# EAGLE design BMS-LV (EAGLE 6.5.0)
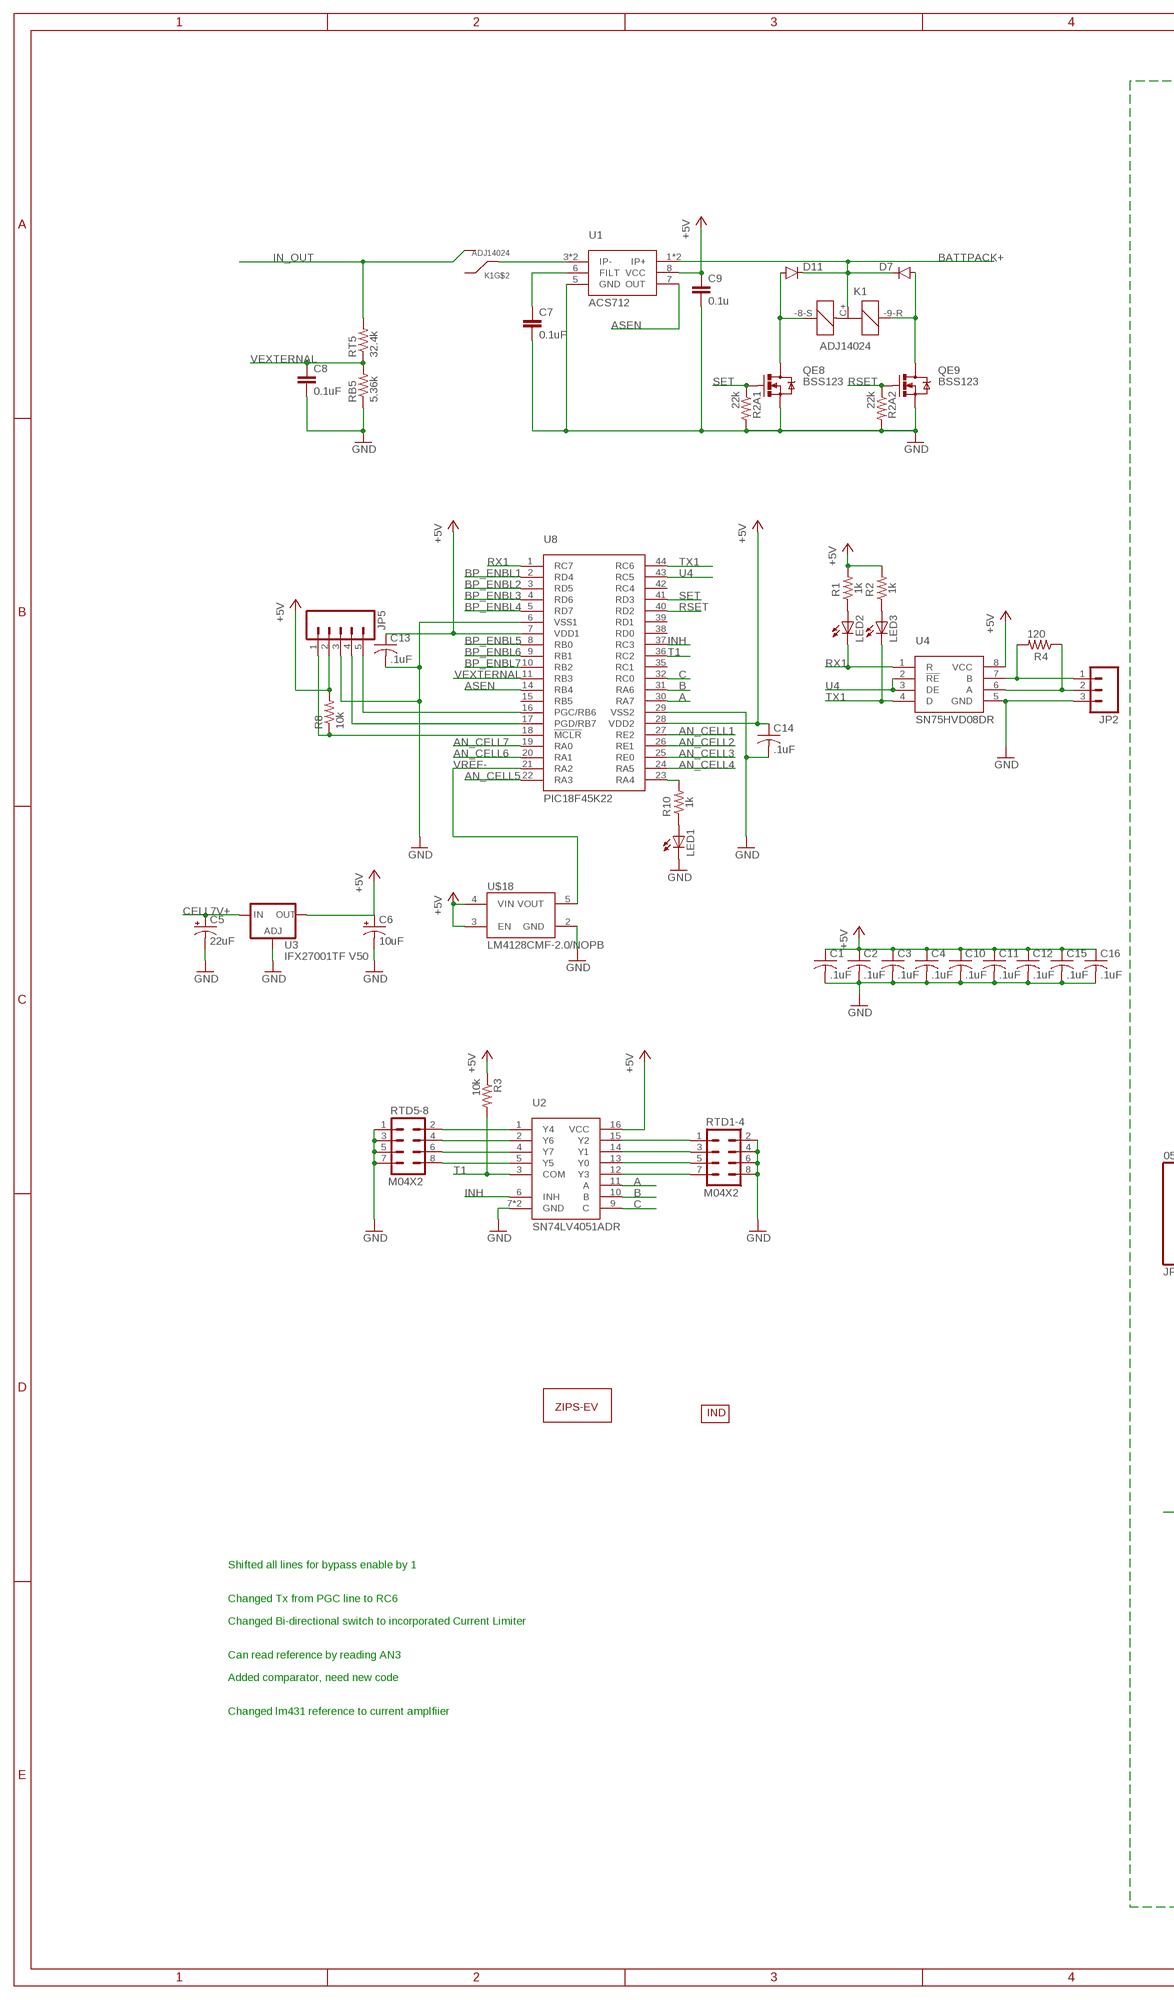
[diagram p0: schematic, sheet 1, part 1 of 2]
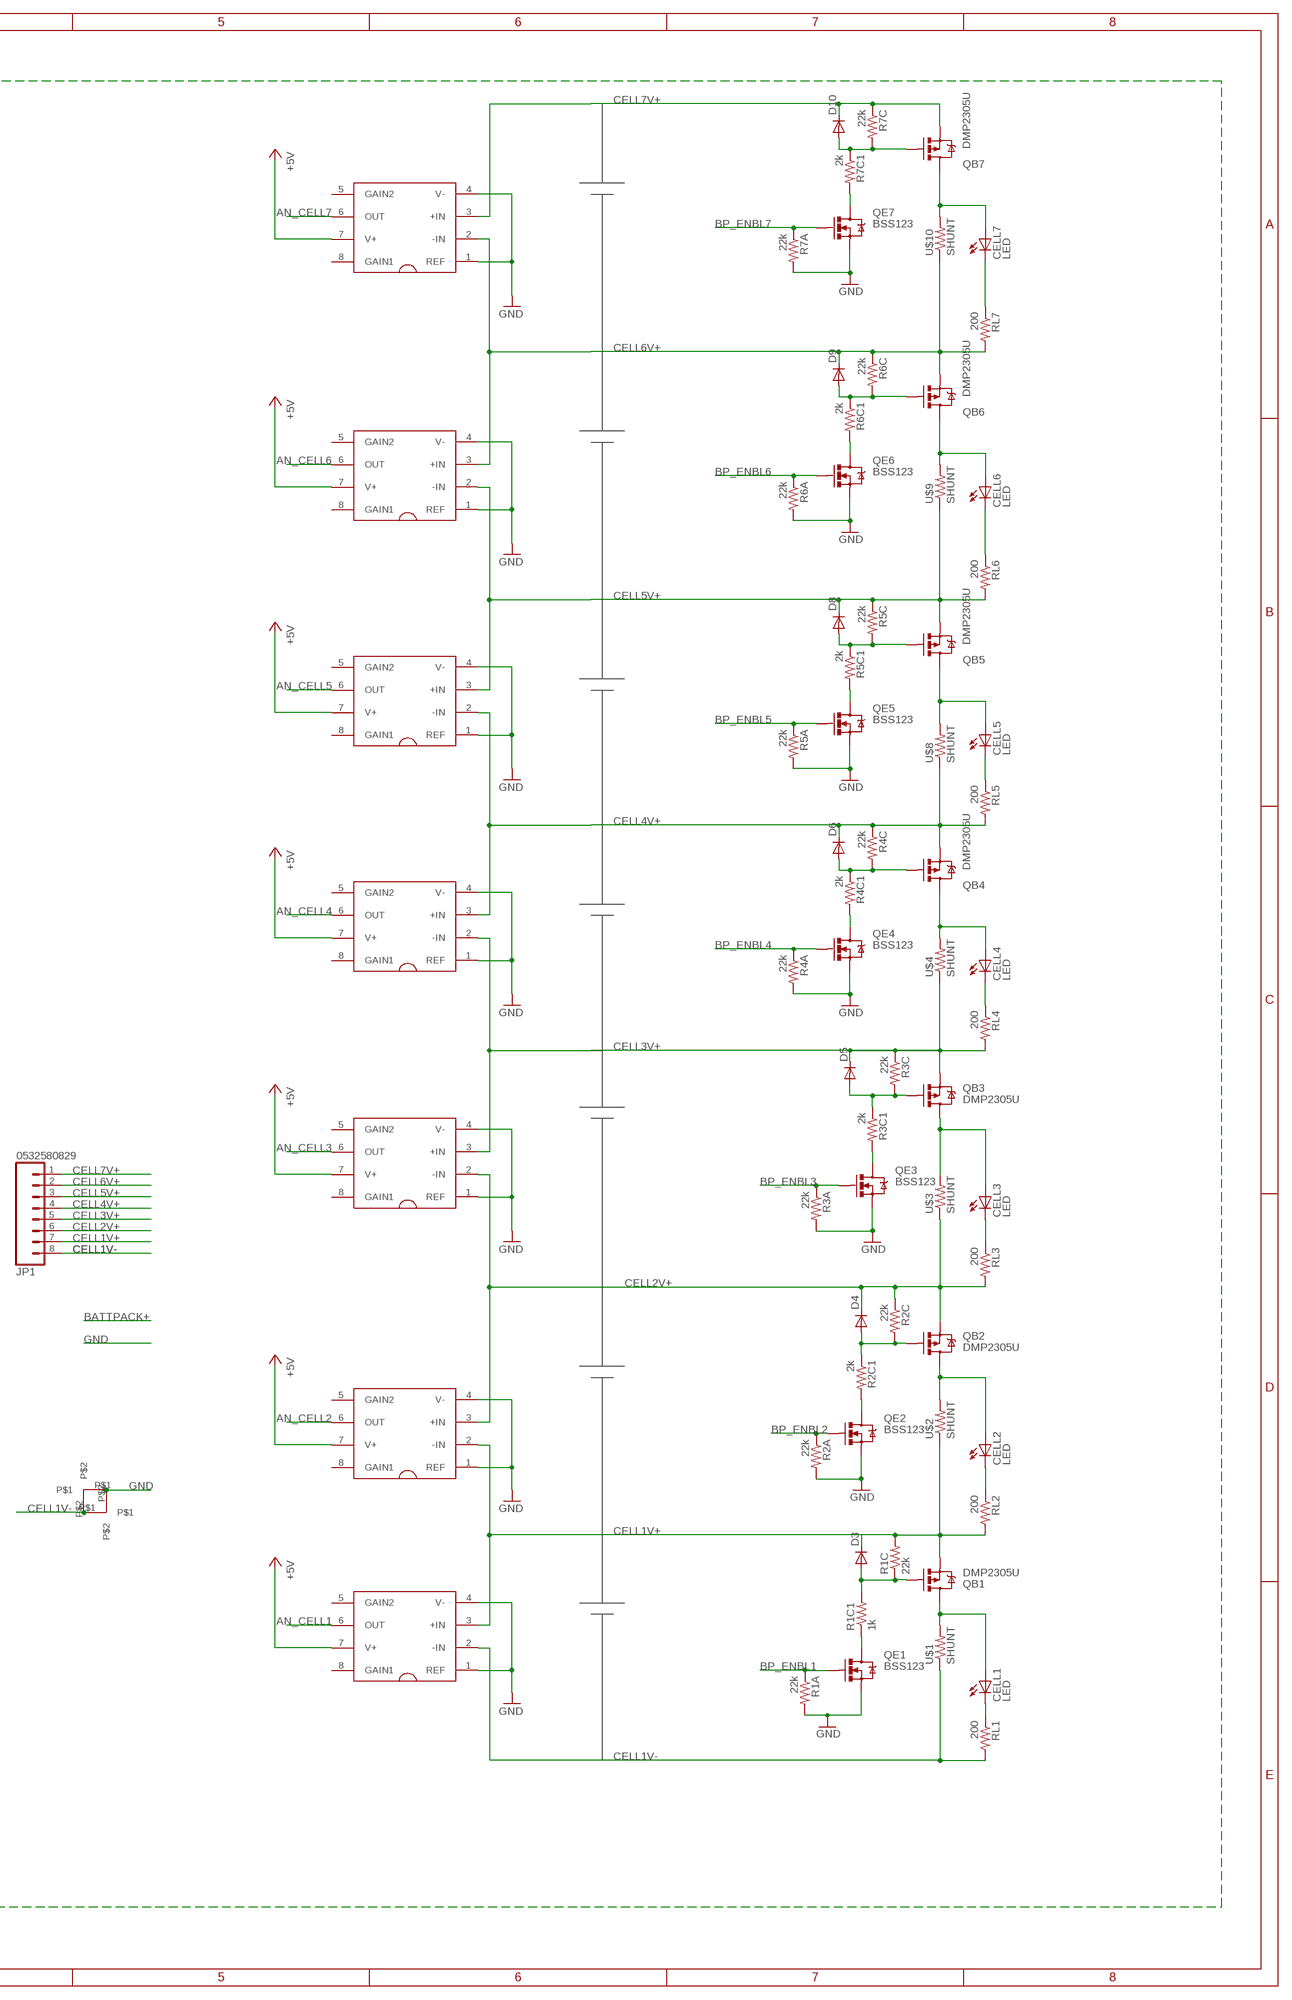
[diagram p1: schematic, sheet 1, part 2 of 2]

## Parts
C1  .1uF  C-USC0805  [C0805]
C2  .1uF  C-USC0805  [C0805]
C3  .1uF  C-USC0805  [C0805]
C4  .1uF  C-USC0805  [C0805]
C5  22uF  CAP_POL7343  [EIA7343]
C6  10uF  CAP_POL1206  [EIA3216]
C7  0.1uF  CAP0805  [0805]
C8  0.1uF  CAP0805  [0805]
C9  0.1u  CAP0805  [0805]
C10  .1uF  C-USC0805  [C0805]
C11  .1uF  C-USC0805  [C0805]
C12  .1uF  C-USC0805  [C0805]
C13  .1uF  C-USC0805  [C0805]
C14  .1uF  C-USC0805  [C0805]
C15  .1uF  C-USC0805  [C0805]
C16  .1uF  C-USC0805  [C0805]
CELL1  LED  LEDSML0805  [SML0805]
CELL2  LED  LEDSML0805  [SML0805]
CELL3  LED  LEDSML0805  [SML0805]
CELL4  LED  LEDSML0805  [SML0805]
CELL5  LED  LEDSML0805  [SML0805]
CELL6  LED  LEDSML0805  [SML0805]
CELL7  LED  LEDSML0805  [SML0805]
D3  DIODE-SOD123  [SOD123]
D4  DIODE-SOD123  [SOD123]
D5  DIODE-SOD123  [SOD123]
D6  DIODE-SOD123  [SOD123]
D7  DIODESMA-ALT  [SMA-DIODE_ALT]
D8  DIODE-SOD123  [SOD123]
D9  DIODE-SOD123  [SOD123]
D10  DIODE-SOD123  [SOD123]
D11  DIODESMA-ALT  [SMA-DIODE_ALT]
JP1  0532580829  M083.5MM-8  [SCREWTERMINAL-3.5MM-8]
JP2  M03POLAR_LOCK  [MOLEX-1X3_LOCK]
JP5  M05LOCK_LONGPADS  [1X05_LOCK_LONGPADS]
K1  ADJ14024  [ADJ14024]
LED1  LEDCHIP-LED0805  [CHIP-LED0805]
LED2  LEDCHIP-LED0805  [CHIP-LED0805]
LED3  LEDCHIP-LED0805  [CHIP-LED0805]
QB1  DMP2305U  [SOT-23]
QB2  DMP2305U  [SOT-23]
QB3  DMP2305U  [SOT-23]
QB4  DMP2305U  [SOT-23]
QB5  DMP2305U  [SOT-23]
QB6  DMP2305U  [SOT-23]
QB7  DMP2305U  [SOT-23]
QE1  BSS123  [SOT-23]
QE2  BSS123  [SOT-23]
QE3  BSS123  [SOT-23]
QE4  BSS123  [SOT-23]
QE5  BSS123  [SOT-23]
QE6  BSS123  [SOT-23]
QE7  BSS123  [SOT-23]
QE8  BSS123  [SOT-23]
QE9  BSS123  [SOT-23]
R1  1k  R-US_R0805  [R0805]
R1A  22k  RESISTOR0805-RES  [0805]
R1C  22k  RESISTOR0805-RES  [0805]
R1C1  1k  RESISTOR0805-RES  [0805]
R2  1k  R-US_R0805  [R0805]
R2A  22k  RESISTOR0805-RES  [0805]
R2A1  22k  RESISTOR0805-RES  [0805]
R2A2  22k  RESISTOR0805-RES  [0805]
R2C  22k  RESISTOR0805-RES  [0805]
R2C1  2k  RESISTOR0805-RES  [0805]
R3  10k  R-US_R0805  [R0805]
R3A  22k  RESISTOR0805-RES  [0805]
R3C  22k  RESISTOR0805-RES  [0805]
R3C1  2k  RESISTOR0805-RES  [0805]
R4  120  R-US_R0805  [R0805]
R4A  22k  RESISTOR0805-RES  [0805]
R4C  22k  RESISTOR0805-RES  [0805]
R4C1  2k  RESISTOR0805-RES  [0805]
R5A  22k  RESISTOR0805-RES  [0805]
R5C  22k  RESISTOR0805-RES  [0805]
R5C1  2k  RESISTOR0805-RES  [0805]
R6A  22k  RESISTOR0805-RES  [0805]
R6C  22k  RESISTOR0805-RES  [0805]
R6C1  2k  RESISTOR0805-RES  [0805]
R7A  22k  RESISTOR0805-RES  [0805]
R7C  22k  RESISTOR0805-RES  [0805]
R7C1  2k  RESISTOR0805-RES  [0805]
R8  10k  RESISTOR0805-RES  [0805]
R10  1k  R-US_R0805  [R0805]
RB5  5.36k  RESISTOR0805-RES  [0805]
RL1  200  RESISTOR0805-RES  [0805]
RL2  200  RESISTOR0805-RES  [0805]
RL3  200  RESISTOR0805-RES  [0805]
RL4  200  RESISTOR0805-RES  [0805]
RL5  200  RESISTOR0805-RES  [0805]
RL6  200  RESISTOR0805-RES  [0805]
RL7  200  RESISTOR0805-RES  [0805]
RT5  32.4k  RESISTOR0805-RES  [0805]
RTD1-4  M04X2  [2X4]
RTD5-8  M04X2  [2X4]
U1  ACS712  [SO-8]
U2  SN74LV4051ADR  [SO-16]
U3  IFX27001TF V50  V_REG_317DPACK  [V-REG_DPACK]
U4  SN75HVD08DR  [SO-8]
U8  PIC18F45K22  [TQFP-44]
U$1  SHUNT  [SM-5]
U$2  SHUNT  [SM-5]
U$3  SHUNT  [SM-5]
U$4  SHUNT  [SM-5]
U$5  VIRTUALGROUND  [VIRTUALSHORT]
U$7  VIRTUALGROUND  [VIRTUALSHORT]
U$8  SHUNT  [SM-5]
U$9  SHUNT  [SM-5]
U$10  SHUNT  [SM-5]
U$11  LT1990  [LT1990]
U$12  LT1990  [LT1990]
U$13  LT1990  [LT1990]
U$14  LT1990  [LT1990]
U$15  LT1990  [LT1990]
U$16  LT1990  [LT1990]
U$17  LT1990  [LT1990]
U$18  LM4128CMF-2.0/NOPB  LM4128-2.5VREF  [SOT23-5]
U$19  INDPK1  [PICKIT-PIN-1]
U$20  LOGO  [L-MS]

## Nets
+5V: C1.1 C2.1 C3.1 C4.1 C6.A(+) C9.1 C10.1 C11.1 C12.1 C13.1 C14.1 C15.1 C16.1 JP5.2 R1.2 R2.2 R3.1 R8.2 U1.8(VCC) U2.16(VCC) U3.4(OUT) U4.8(VCC) U8.7(VDD1) U8.28(VDD2) U$11.7(V+) U$12.7(V+) U$13.7(V+) U$14.7(V+) U$15.7(V+) U$16.7(V+) U$17.7(V+) U$18.3(EN) U$18.4(VIN)
A: U2.11(A) U8.30(RA7)
AN_CELL1: U8.27(RE2) U$11.6(OUT)
AN_CELL2: U8.26(RE1) U$12.6(OUT)
AN_CELL3: U8.25(RE0) U$13.6(OUT)
AN_CELL4: U8.24(RA5) U$14.6(OUT)
AN_CELL5: U8.22(RA3) U$15.6(OUT)
AN_CELL6: U8.20(RA1) U$16.6(OUT)
AN_CELL7: U8.19(RA0) U$17.6(OUT)
ASEN: U1.7(OUT) U8.14(RB4)
B: U2.10(B) U8.31(RA6)
BATTPACK+: D7.C D11.C K1.C+(-) U1.1(IP+) U1.2(IP+)
BP_ENBL1: QE1.1(G) R1A.1 U8.2(RD4)
BP_ENBL2: QE2.1(G) R2A.1 U8.3(RD5)
BP_ENBL3: QE3.1(G) R3A.1 U8.4(RD6)
BP_ENBL4: QE4.1(G) R4A.1 U8.5(RD7)
BP_ENBL5: QE5.1(G) R5A.1 U8.8(RB0)
BP_ENBL6: QE6.1(G) R6A.1 U8.9(RB1)
BP_ENBL7: QE7.1(G) R7A.1 U8.10(RB2)
C: U2.9(C) U8.32(RC0)
CELL1V+: D3.C JP1.7 QB1.2(S) R1C.2 RL2.2 U$2.P$1 U$11.3(+IN) U$12.2(-IN)
CELL1V-: JP1.8 RL1.2 U$1.P$1 U$5.P$1 U$7.P$2 U$11.2(-IN)
CELL2V+: D4.C JP1.6 QB2.2(S) R2C.1 RL3.2 U$3.P$1 U$12.3(+IN) U$13.2(-IN)
CELL3V+: D5.C JP1.5 QB3.2(S) R3C.1 RL4.2 U$4.P$1 U$13.3(+IN) U$14.2(-IN)
CELL4V+: D6.C JP1.4 QB4.2(S) R4C.1 RL5.2 U$8.P$1 U$14.3(+IN) U$15.2(-IN)
CELL5V+: D8.C JP1.3 QB5.2(S) R5C.1 RL6.2 U$9.P$1 U$15.3(+IN) U$16.2(-IN)
CELL6V+: D9.C JP1.2 QB6.2(S) R6C.1 RL7.2 U$10.P$1 U$16.3(+IN) U$17.2(-IN)
CELL7V+: C5.A(+) D10.C JP1.1 QB7.2(S) R7C.1 U3.3(IN) U$17.3(+IN)
GND: C1.2 C2.2 C3.2 C4.2 C5.C(-) C6.C(-) C7.2 C8.2 C9.2 C10.2 C11.2 C12.2 C13.2 C14.2 C15.2 C16.2 JP2.3 JP5.3 LED1.C QE1.2(S) QE2.2(S) QE3.2(S) QE4.2(S) QE5.2(S) QE6.2(S) QE7.2(S) QE8.2(S) QE9.2(S) R1A.2 R2A1.2 R2A2.2 R2A.2 R3A.2 R4A.2 R5A.2 R6A.2 R7A.2 RB5.1 RTD1-4.2 RTD1-4.4 RTD1-4.6 RTD1-4.8 RTD5-8.1 RTD5-8.3 RTD5-8.5 RTD5-8.7 U1.5(GND) U2.7(GND) U2.8(GND) U3.1(ADJ) U4.5(GND) U8.6(VSS1) U8.29(VSS2) U$5.P$2 U$7.P$1 U$11.1(REF) U$11.4(V-) U$12.1(REF) U$12.4(V-) U$13.1(REF) U$13.4(V-) U$14.1(REF) U$14.4(V-) U$15.1(REF) U$15.4(V-) U$16.1(REF) U$16.4(V-) U$17.1(REF) U$17.4(V-) U$18.2(GND)
IN_OUT: K1.NO RT5.2
INH: U2.6(INH) U8.37(RC3)
N$1: LED2.A R1.1
N$3: LED3.A R2.1
N$5: D4.A QB2.1(G) R2C1.1 R2C.2
N$7: D11.A K1.-8-S(+1) QE8.3(D)
N$10: JP5.4 U8.17(PGD/RB7)
N$11: QE1.3(D) R1C1.1
N$12: D5.A QB3.1(G) R3C1.1 R3C.2
N$13: D6.A QB4.1(G) R4C1.1 R4C.2
N$14: D3.A QB1.1(G) R1C1.2 R1C.1
N$15: CELL1.A QB1.3(D) U$1.P$2
N$17: K1.C U1.3(IP-) U1.4(IP-)
N$18: CELL2.A QB2.3(D) U$2.P$2
N$19: CELL4.A QB4.3(D) U$4.P$2
N$20: D7.A K1.-9-R(+2) QE9.3(D)
N$21: CELL1.C RL1.1
N$22: QE4.3(D) R4C1.2
N$23: CELL3.C RL3.1
N$24: R10.2 U8.23(RA4)
N$25: CELL3.A QB3.3(D) U$3.P$2
N$26: RTD1-4.1 U2.15(Y2)
N$27: C7.1 U1.6(FILT)
N$28: RTD1-4.3 U2.14(Y1)
N$29: JP2.2 R4.1 U4.6(A)
N$30: RTD1-4.5 U2.13(Y0)
N$31: RTD1-4.7 U2.12(Y3)
N$32: CELL2.C RL2.1
N$33: JP2.1 R4.2 U4.7(B)
N$34: CELL4.C RL4.1
N$35: QE2.3(D) R2C1.2
N$36: QE3.3(D) R3C1.2
N$39: JP5.5 U8.16(PGC/RB6)
N$42: RTD5-8.2 U2.1(Y4)
N$44: D8.A QB5.1(G) R5C1.1 R5C.2
N$45: CELL5.A QB5.3(D) U$8.P$2
N$46: CELL5.C RL5.1
N$48: QE5.3(D) R5C1.2
N$50: D9.A QB6.1(G) R6C1.1 R6C.2
N$51: CELL6.A QB6.3(D) U$9.P$2
N$52: CELL6.C RL6.1
N$53: D10.A QB7.1(G) R7C1.1 R7C.2
N$54: QE6.3(D) R6C1.2
N$55: CELL7.A QB7.3(D) U$10.P$2
N$56: CELL7.C RL7.1
N$57: QE7.3(D) R7C1.2
N$58: JP5.1 R8.1 U8.18(!MCLR)
N$59: LED1.A R10.1
N$60: RTD5-8.4 U2.2(Y6)
N$61: RTD5-8.6 U2.4(Y7)
N$62: RTD5-8.8 U2.5(Y5)
RSET: QE9.1(G) R2A2.1 U8.40(RD2)
RX1: LED2.C U4.1(R) U8.1(RC7)
SET: QE8.1(G) R2A1.1 U8.41(RD3)
T1: R3.2 U2.3(COM) U8.36(RC2)
TX1: LED3.C U4.4(D) U8.44(RC6)
U4: U4.2(!RE) U4.3(DE) U8.43(RC5)
VEXTERNAL: C8.1 RB5.2 RT5.1 U8.11(RB3)
VREF-: U8.21(RA2) U$18.5(VOUT)
Unconnected: K1.NC U8.15(RB5) U8.35(RC1) U8.38(RD0) U8.39(RD1) U8.42(RC4) U$11.5(GAIN2) U$11.8(GAIN1) U$12.5(GAIN2) U$12.8(GAIN1) U$13.5(GAIN2) U$13.8(GAIN1) U$14.5(GAIN2) U$14.8(GAIN1) U$15.5(GAIN2) U$15.8(GAIN1) U$16.5(GAIN2) U$16.8(GAIN1) U$17.5(GAIN2) U$17.8(GAIN1)

## Notes on the sheet
- Shifted all lines for bypass enable by 1
- Changed Tx from PGC line to RC6
- Changed Bi-directional switch to incorporated Current Limiter
- Can read reference by reading AN3
- Added comparator, need new code
- Changed lm431 reference to current amplfiier

## Library data of the parts
C1-C4 C10-C16 = adafruit:C-US: CAPACITOR, American symbol
C5 C6 = SparkFun-Passives:CAP_POL: Capacitor Polarized These are standard SMD and PTH capacitors. Normally 10uF, 47uF, and 100uF in electrolytic and tantalum varieties. Always verify the external diameter of the through hole cap, it varies with capacity, voltage, and manufacturer. The EIA devices should be standard.
C7-C9 = SparkFun:CAP: Capacitor Standard 0603 ceramic capacitor, and 0.1" leaded capacitor.
CELL1-CELL7 = led:LED: LED
D3-D6 D8-D10 = diode:DIODE-: DIODE
D7 D11 = SparkFun-DiscreteSemi:DIODE: Diode These are standard reverse protection diodes and small signal diodes. SMA package can handle up to about 1A. SOD-323 can handle about 200mA. What the SOD-323 package when ordering, there are some mfgs out there that are 5-pin packages.
JP1 = SparkFun-Connectors:M08: Header 8 Standard 8-pin 0.1" header. Use with straight break away headers (SKU : PRT-00116), right angle break away headers (PRT-00553), swiss pins (PRT-00743), machine pins (PRT-00117), and female headers (PRT-00115).
JP2 = SparkFun-Connectors:M03: Header 3 Standard 3-pin 0.1" header. Use with straight break away headers (SKU : PRT-00116), right angle break away headers (PRT-00553), swiss pins (PRT-00743), machine pins (PRT-00117), and female headers (PRT-00115). Molex polarized connector foot print use with SKU : PRT-08232 with associated crimp pins and housings.
JP5 = SparkFun-Connectors:M05: Header 5 Standard 5-pin 0.1" header. Use with straight break away headers (SKU : PRT-00116), right angle break away headers (PRT-00553), swiss pins (PRT-00743), machine pins (PRT-00117), and female headers (PRT-00115). Molex polarized connector foot print use with SKU : PRT-08230 with associated crimp pins and housings.
K1 = FSAE Eletric:ADJ14024
LED1-LED3 = adafruit:LED: LED
QB1-QB7 = DFT:DMP2305U
QE1-QE9 = DFT:BSS123
R1-R4 R10 = adafruit:R-US_: RESISTOR, American symbol
R1A R1C R1C1 R2A R2A1 R2A2 R2C R2C1 R3A R3C R3C1 R4A R4C R4C1 R5A R5C R5C1 R6A R6C R6C1 R7A R7C R7C1 RB5 RL1-RL7 RT5 = SparkFun:RESISTOR: Resistor Basic schematic elements and footprints for 0603, 1206, and PTH resistors.
R8 = SparkFun-Passives:RESISTOR: Resistor Basic schematic elements and footprints for 0603, 1206, and PTH resistors.
RTD1-4 RTD5-8 = SparkFun-Connectors:M04X2: .1" header, two rows of four.
U1 = FSAE Eletric:ACS712
U2 = FSAE Eletric:SN74LV4051ADR
U3 = SparkFun-PowerIC:V_REG_317: Voltage Regulator Standard LM317 adjustable voltage regulator. AOI (Adjust Output Input). Google 'LM317 Calculator' for easy to use app to get the two resistor values needed. 240/720 for 5V output. 240/390 for 3.3V output. Spark Fun Electronics SKU : COM-00527; PROD_ID: IC-09888
U4 = FSAE Eletric:SN75HVD08DR
U8 = FSAE Eletric:PIC18F45K22
U$1-U$4 U$8-U$10 = DFT:SHUNT
U$5 U$7 = DFT:VIRTUALGROUND
U$11-U$17 = Sam_Request:LT1990
U$18 = SparkFun-PowerIC:LM4128-2.5VREF: .1% accurate low-current voltage reference
U$19 = FSAE Eletric:IND
U$20 = Pic:LOGO

## Board
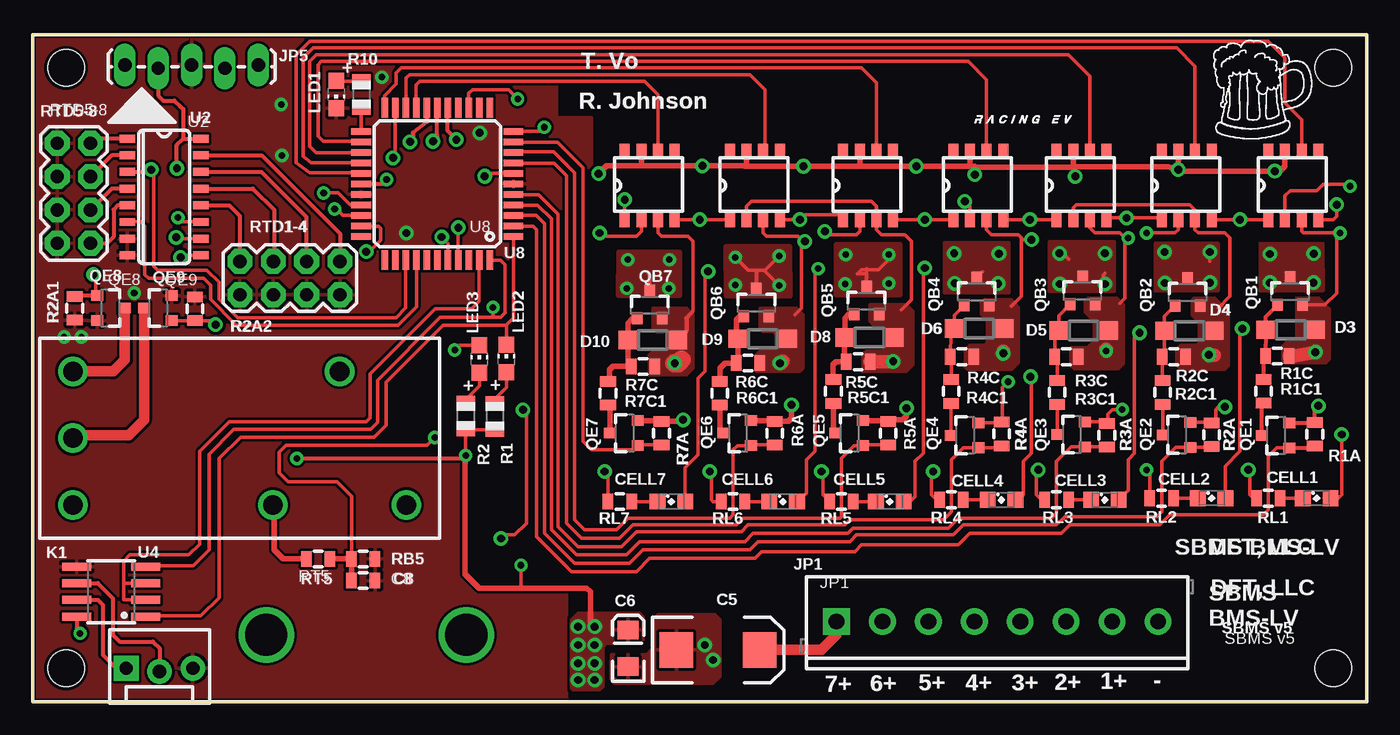
[diagram p2: board, top side]
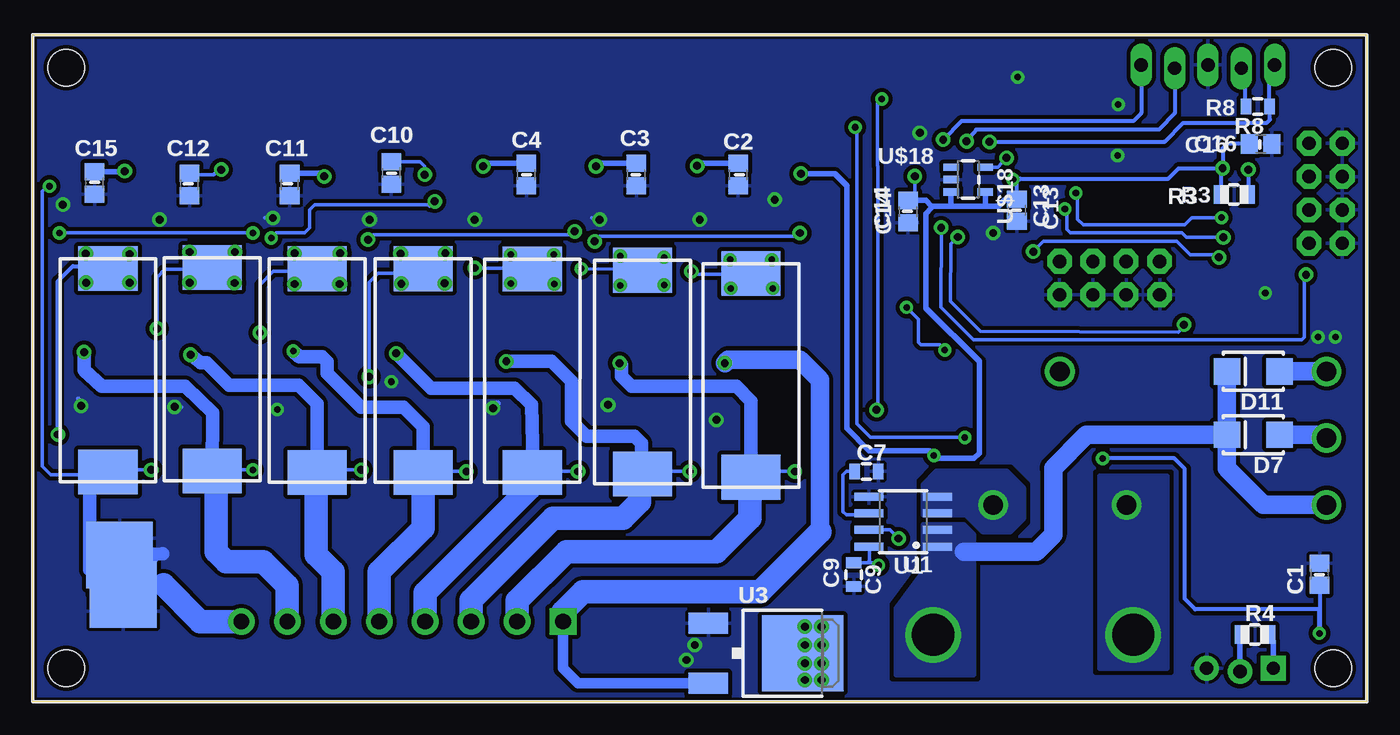
[diagram p3: board, bottom side, seen from below]

Size 101.6 x 50.8 mm. Coordinates in mm from the lower left corner, seen from the top.
Outline: 0,0 101.6,0 101.6,50.8 0,50.8 0,0
Copper layers (1*16): Top 0.035mm / dielectric 1.5mm / Bottom 0.035mm
Design rules "SparkFun": minimum track width 8mil, minimum drill 20mil, track to track 8mil, track to pad 8mil, pad to pad 8mil, via to via 8mil, smd to smd 8mil, copper to edge 10mil, drill to drill 8mil, minimum pad ring 12mil, minimum via ring 10mil, stop-mask expansion 4mil, vias tented up to drill 25mil, thermal gap 10mil
Holes 2.8 mm at 2.54,48.26 99.06,48.26 99.06,2.54 2.54,2.54

### Footprints (pad centres in the part's own frame; a part is rotated, then mirrored left to right if it is on the bottom)
C0805 = smd 1.3 x 1.5: 1 -0.85,0; 2 0.85,0
EIA7343 = smd 2.55 x 2.7: A 3.17,0; C -3.17,0
EIA3216 = smd 1.4 x 1.6: A 1.4,0; C -1.4,0
0805 = smd 0.8 x 1.2: 1 -0.9,0; 2 0.9,0
SML0805 = smd 1.2 x 1.2: A 1.05,0; C -1.05,0
SOD123 = smd 1.4 x 1.4: A 1.9,0; C -1.9,0
SMA-DIODE_ALT = smd 2 x 2: A -2,0; C 2,0
SCREWTERMINAL-3.5MM-8 = drill 1.2 pad 2.032 square: 1 0,0 | drill 1.2 pad 2.032: 2 3.5,0; 3 7,0; 4 10.5,0; 5 14,0; 6 17.5,0; 7 21,0; 8 24.5,0
MOLEX-1X3_LOCK = drill 1.016 pad 1.88 square: 1 0,0.127 | drill 1.016 pad 1.88: 2 2.54,-0.127; 3 5.08,0.127
1X05_LOCK_LONGPADS = drill 1.016 long: 1 0,0; 2 2.54,-0.254; 3 5.08,0; 4 7.62,-0.254; 5 10.16,0
ADJ14024 = drill 1.5: -8-S 0,5.08; -9-R 0,0; C 25.4,-5.08; C+ 0,-5.08; NC 20.32,5.08; NO 15.24,-5.08
CHIP-LED0805 = smd 1.2 x 1.2: A 0,-1.05; C 0,1.05
SOT-23 = smd 0.8 x 0.9: 1 -0.95,-0.23; 2 0.95,-0.23; 3 0,1.87
R0805 = smd 1.1 x 1.4: 1 -1,0; 2 1,0
2X4 = drill 1.016 pad 1.88 octagon: 1 -3.81,-1.27; 2 -3.81,1.27; 3 -1.27,-1.27; 4 -1.27,1.27; 5 1.27,-1.27; 6 1.27,1.27; 7 3.81,-1.27; 8 3.81,1.27
SO-8 = smd 0.61 x 2.21: 1 -1.905,-2.616; 2 -0.635,-2.616; 3 0.635,-2.616; 4 1.905,-2.616; 5 1.905,2.616; 6 0.635,2.616; 7 -0.635,2.616; 8 -1.905,2.616
SO-16 = smd 0.6 x 1.2: 1 -4.445,-2.8; 2 -3.175,-2.8; 3 -1.905,-2.8; 4 -0.635,-2.8; 5 0.635,-2.8; 6 1.905,-2.8; 7 3.175,-2.8; 8 4.445,-2.8; 9 4.445,2.8; 10 3.175,2.8; 11 1.905,2.8; 12 0.635,2.8; 13 -0.635,2.8; 14 -1.905,2.8; 15 -3.175,2.8; 16 -4.445,2.8
V-REG_DPACK = smd 1.6 x 3: 1 -2.28,-4.8; 3 2.28,-4.8 | smd 5.8 x 6.2: 4 0,2.38
TQFP-44 = smd 1.5 x 0.5: 1 -5.8,4; 2 -5.8,3.2; 3 -5.8,2.4; 4 -5.8,1.6; 5 -5.8,0.8; 6 -5.8,0; 7 -5.8,-0.8; 8 -5.8,-1.6; 9 -5.8,-2.4; 10 -5.8,-3.2; 11 -5.8,-4; 23 5.8,-4; 24 5.8,-3.2; 25 5.8,-2.4; 26 5.8,-1.6; 27 5.8,-0.8; 28 5.8,0; 29 5.8,0.8; 30 5.8,1.6; 31 5.8,2.4; 32 5.8,3.2; 33 5.8,4 | smd 0.5 x 1.5: 12 -4,-5.8; 13 -3.2,-5.8; 14 -2.4,-5.8; 15 -1.6,-5.8; 16 -0.8,-5.8; 17 0,-5.8; 18 0.8,-5.8; 19 1.6,-5.8; 20 2.4,-5.8; 21 3.2,-5.8; 22 4,-5.8; 34 4,5.8; 35 3.2,5.8; 36 2.4,5.8; 37 1.6,5.8; 38 0.8,5.8; 39 0,5.8; 40 -0.8,5.8; 41 -1.6,5.8; 42 -2.4,5.8; 43 -3.2,5.8; 44 -4,5.8
SM-5 = smd 3.4 x 4.5: P$1 -7.75,0; P$2 7.75,0
VIRTUALSHORT = smd 2.54 x 5.08: P$1 -1.27,0; P$2 1.27,0
LT1990 = smd 0.762 x 1.143: 1 0,0; 2 1.27,0; 3 2.54,0; 4 3.81,0; 5 3.81,5.207; 6 2.54,5.207; 7 1.27,5.207; 8 0,5.207
SOT23-5 = smd 0.55 x 1.2: 1 -0.95,-1.3; 2 0,-1.3; 3 0.95,-1.3; 4 0.95,1.3; 5 -0.95,1.3
